# EAGLE board Mk4 Final a (EAGLE 9.0.1), part 2 of 3 (continued)
## Tracks (layer width: path | path; a pad name or v marks a point on that pad's centre or on a via) (continued)
I2C5_EXT_SCL  (via drill 0.3)  (3 unrouted)
  Top 0.2: J8.1 36.58,72.69 arc-45 36.29,71.99 35.69,71.39 arc-45 34.99,71.1 22.42,71.1 arc45 21.53,70.73 17.39,66.59 arc-45 16.69,66.3 14.32,66.3 arc45 13.43,65.93 13.07,65.57 arc45 12.7,64.68 12.7,63.27 arc-45 12.26,62.21 10.69,60.64 arc-45 9.63,60.2 3.85,60.2 arc90 2.6,58.95 2.6,48.21 arc45 2.89,47.51 4.61,45.79 arc-45 4.9,45.09 4.9,40.31 arc45 5.19,39.61 v5.3,39.5 | v38.05,71.25 arc-45 38.3,70.65 38.3,67.15 arc90 40.05,65.4 50.65,65.4 v50.8,65.25
  3V3@2 0.15: v50.8,65.25 50.8,62 51.3,61.5 55.82,61.5 56.4,60.92 56.4,58.32 58.07,56.65 58.07,56.38 58.38,56.08 58.65,56.08 63.9,50.82 v63.9,50.2
  Bottom 0.15: IC1.121 66.69,49.6 66.66,49.63 arc45 66.31,49.77 66.18,49.77 arc-45 65.47,50.07 65.01,50.53 arc45 64.66,50.67 64.58,50.67 arc45 64.23,50.53 v63.9,50.2
  Bottom 0.2: IC1.121 68.59,49.6 arc-45 68.95,49.45 69.05,49.35 arc45 69.41,49.2 70.07,49.2 arc-45 70.42,49.05 71.15,48.33 71.15,48.15 R24.1 72,47.3 72,46.95 arc45 72.13,46.63 arc-45 72.42,45.92 72.42,41.82 arc45 72.72,41.11 73.21,40.62 arc45 73.92,40.33 75.56,40.33 arc-45 76.27,40.03 82.18,34.12 arc-45 82.55,33.23 82.55,27.33 arc45 82.99,26.27 87.8,21.46 arc45 88.86,21.02 92.46,21.02 arc-45 93.34,20.66 96.91,17.09 arc-45 97.2,16.39 97.2,9.51 | JP6.6 5.25,39.45 v5.3,39.5 | PCB.SCL 97.6,5 97.2,5.4 97.2,9.51 | J8.1 36.8,73.36 36.8,72.91 arc45 37.09,72.21 v38.05,71.25 | J11.3 98.86,7.85 arc-45 98.15,8.15 97.49,8.81 arc-45 97.2,9.51
  Bottom 0.3: PCB.SCL 98.05,4.84 | J8.5 J8.1
I2C5_EXT_SDA  (via drill 0.3)  (3 unrouted)
  Top 0.2: v5.55,42 5.52,42.02 arc-45 5.3,42.57 5.3,45.24 arc45 5.01,45.94 3.29,47.66 arc-45 3,48.36 3,58.8 arc-90 4,59.8 9.67,59.8 arc45 10.91,60.31 12.59,61.99 arc45 13.1,63.23 13.1,64.64 arc-45 13.39,65.34 13.66,65.61 arc-45 14.36,65.9 16.73,65.9 arc45 17.62,66.27 21.81,70.46 arc-45 22.51,70.75 35.64,70.75 arc45 36.34,71.04 38.56,73.26 J8.2 38.56,73.24 38.7,73.1 38.7,67.3 arc90 40.2,65.8 50.6,65.8 v50.8,66
  3V3@2 0.15: v63.1,50.2 63.1,51.2 58.52,55.77 58.26,55.77 57.77,56.26 57.77,56.52 56.1,58.2 56.1,60.8 55.7,61.2 51.1,61.2 50.5,61.8 50.5,64.7 50.2,65 50.2,65.4 v50.8,66
  Bottom 0.15: IC1.120 66.72,50 arc-45 66.71,50 arc45 66.54,50.08 arc-45 65.83,50.37 65.52,50.68 arc45 64.81,50.98 64.29,50.98 arc45 63.58,50.68 v63.1,50.2
  Bottom 0.2: IC1.120 68.72,50 arc-45 69.08,49.85 69.23,49.7 arc45 69.58,49.56 70.79,49.56 arc-45 71.14,49.41 R23.1 72,48.55 arc45 72.36,48.4 72.7,48.4 arc-90 73.2,47.9 73.2,47.21 arc-45 72.91,46.51 72.77,46.38 72.77,41.96 arc45 73.07,41.26 73.36,40.97 arc45 74.06,40.67 75.71,40.67 arc-45 76.42,40.38 82.46,34.34 arc-45 82.9,33.28 82.9,27.37 arc45 83.27,26.49 87.99,21.77 arc45 88.87,21.4 93.29,21.4 arc-45 93.99,21.11 97.36,17.75 arc-45 97.65,17.04 97.65,10.92 arc45 97.94,10.21 J11.4 99.89,9.65 arc-45 100.59,9.36 103.51,6.44 arc-45 PCB.SDA | JP6.7 v5.54,41.99 v5.55,42
  Bottom 0.3: J8.6 J8.2
JOY_CEN  (via drill 0.3)  (1 unrouted)
  Top 0.15: SW1.CTR 20.57,39.02 arc45 21.46,38.66 24.59,38.66 arc-45 24.95,38.51 24.96,38.5 arc45 25.32,38.35 25.58,38.35 arc-45 25.93,38.2 27.29,36.84 arc45 28.18,36.48 34.24,36.48 arc45 34.41,36.55 34.54,36.68 arc-45 34.72,36.75 48.08,36.75 arc90 49.25,37.92 49.25,41.59 arc-90 50.36,42.7 52.65,42.7 arc90 53.9,43.95 53.9,44.35 arc-90 55.15,45.6 56.72,45.6 arc45 57.07,45.75 57.55,46.23 arc45 57.7,46.58 57.7,47.09 arc-45 57.85,47.45 v59,48.6
  Bottom 0.15: v59,48.6 58.79,48.81 arc-45 58.5,49.51 58.5,54.09 arc45 58.21,54.79 56.69,56.31 arc-45 56.4,57.01 IC1.72
JOY_DOWN  (via drill 0.3)  (1 unrouted)
  Top 0.15: v59.8,47.8 59.8,47.41 arc-45 59.51,46.71 57.65,44.85 arc-45 57.29,44.7 55.3,44.7 arc90 54.8,44.2 54.8,43.8 arc-90 52.8,41.8 50.74,41.8 arc90 50.15,41.2 50.15,37.52 arc-90 48.47,35.85 35.09,35.85 arc45 34.92,35.78 34.79,35.65 arc-45 34.61,35.58 24.88,35.58 arc45 24.53,35.43 23.95,34.85 arc-45 23.59,34.7 23.1,34.7 SW1.D
  Bottom 0.15: v59.8,47.8 59.9,47.9 59.9,48.61 arc45 59.61,49.32 59.39,49.53 arc-45 59.1,50.24 59.1,54.69 arc45 58.81,55.39 57.49,56.71 arc-45 57.2,57.41 IC1.74
JOY_LEFT  (via drill 0.3)  (1 unrouted)
  Top 0.15: SW1.C 17.45,40.35 arc45 18.15,40.06 18.66,40.06 arc-45 19.36,39.76 20.33,38.8 arc45 21.39,38.36 24.47,38.36 arc-45 24.82,38.21 24.84,38.2 arc45 25.19,38.05 25.45,38.05 arc-45 25.8,37.9 27.09,36.61 arc45 28.15,36.17 34.23,36.17 arc45 34.63,36.34 34.67,36.38 arc-45 34.84,36.45 48.19,36.45 arc90 49.55,37.81 49.55,41.46 arc-90 50.49,42.4 52.7,42.4 arc90 54.2,43.9 54.2,44.3 arc-90 55.2,45.3 56.84,45.3 arc45 57.2,45.45 57.85,46.1 arc45 58,46.46 58,46.59 arc-45 58.15,46.95 v59,47.8
  Bottom 0.15: IC1.73 56.8,57.21 arc45 57.09,56.51 58.51,55.09 arc-45 58.8,54.39 58.8,50.11 arc45 59.09,49.41 59.31,49.19 arc-45 59.6,48.49 arc-45 59.54,48.34 v59,47.8
JOY_RIGHT  (via drill 0.3)  (1 unrouted)
  Top 0.15: v59,47 58.88,47 arc45 58.53,46.85 58.45,46.77 arc45 58.3,46.42 58.3,46.33 arc-45 58.15,45.98 57.32,45.15 arc-45 56.97,45 55.25,45 arc90 54.5,44.25 54.5,43.85 arc-90 52.75,42.1 50.6,42.1 arc90 49.85,41.35 49.85,37.69 arc-90 48.31,36.15 34.97,36.15 arc45 34.79,36.08 34.66,35.95 arc-45 34.49,35.88 25.73,35.88 arc-45 25.38,36.02 SW1.B | v61.8,54.6 arc-45 62.04,54.7 v63.1,54.7
  Bottom 0.15: v61.8,54.6 60.4,54.6 arc90 59.4,53.6 59.4,50.41 arc45 59.69,49.71 60.11,49.29 arc-45 60.4,48.59 60.4,48 arc-90 59.4,47 v59,47 | IC1.91 64,59.79 64.08,59.72 64.08,59.48 arc-90 63.57,58.98 63.27,58.98 arc90 62.77,58.48 62.77,55.44 arc45 63.07,54.73 v63.1,54.7
JOY_UP  (via drill 0.3)  (1 unrouted)
  Top 0.15: SW1.A 19.2,42.2 arc-45 19.49,41.49 19.49,41 arc45 19.79,40.29 20.82,39.25 arc45 21.53,38.96 24.72,38.96 arc-45 25.07,38.81 25.09,38.8 arc45 25.44,38.65 25.7,38.65 arc-45 26.05,38.5 27.49,37.07 arc45 28.2,36.77 34.11,36.77 arc45 34.29,36.85 34.42,36.98 arc-45 34.6,37.05 47.95,37.05 arc90 48.95,38.05 48.95,41.72 arc-90 50.23,43 52.6,43 arc90 53.6,44 53.6,44.4 arc-90 55.1,45.9 56.59,45.9 arc45 56.95,46.05 57.25,46.35 arc45 57.4,46.71 57.4,47.59 arc-45 57.55,47.95 v58.2,48.6
  Bottom 0.15: IC1.71 56,56.81 arc45 56.29,56.11 57.91,54.49 arc-45 58.2,53.79 v58.2,48.6
LCD_!RST  (via drill 0.3)
  Top 0.15: v65.4,53.6 65.4,51.91 arc45 65.69,51.21 69.23,47.67 arc45 69.58,47.52 70.06,47.52 arc-45 70.41,47.38 70.75,47.05 arc45 71.1,46.9 v71.4,46.9
  Bottom 0.15: IC1.111 v65.4,53.6 | v71.4,46.9 71.81,46.49 arc-45 72.1,45.79 72.1,42.21 arc-45 71.81,41.5 71.67,41.36 arc45 71.52,41.01 71.52,40.9 arc-90 71.02,40.4 68.55,40.4 arc90 67.55,39.4 J2.10
LCD_DCX
  Bottom 0.15: J2.36 54.55,37.89 arc-45 54.84,38.59 55.01,38.76 arc45 55.3,39.46 55.3,41.69 arc-45 55.45,42.05 56.45,43.05 arc-45 56.81,43.2 56.94,43.2 arc45 57.3,43.35 58.25,44.3 arc45 58.4,44.66 IC1.20
LCD_TEAR  (via drill 0.3)
  Top 0.15: v52.95,38.5 52.95,40.19 arc-45 53.24,40.89 53.56,41.21 arc-45 54.26,41.5 54.39,41.5 arc45 55.09,41.79 55.11,41.81 arc45 55.4,42.51 v55.4,43
  Bottom 0.15: J2.39 53.05,38.26 arc45 v52.95,38.5 | IC1.21 58,44.68 arc-45 57.85,44.33 57.17,43.65 arc-45 56.82,43.5 56.68,43.5 arc45 56.33,43.35 56.12,43.15 arc-45 55.77,43 v55.4,43
LED1  (via drill 0.3)
  Top 0.15: v59.8,67.5 59.8,71.09 arc45 59.51,71.79 58.17,73.12 58.04,73.12 57.66,73.5 v57.55,73.5
  Bottom 0.15: IC1.86 62,61.23 arc90 61.3,61.92 arc-90 60.8,62.42 60.8,63.29 arc45 60.51,63.99 60.09,64.41 arc-45 59.8,65.11 v59.8,67.5 | R12.2 60.59,73.52 arc-45 59.88,73.22 57.82,73.22 v57.55,73.5
LED1_R  (via drill 0.3)
  Top 0.25: LED3.A v61.97,75.25
  Bottom 0.3: R12.1 61.32,75.25 v61.97,75.25
LED2  (via drill 0.3)
  Top 0.15: v58.8,67.55 57.55,68.8 arc-45 57.26,69.5 57.26,73.04 v56.8,73.5
  Bottom 0.15: IC1.85 61.6,61.33 arc90 61.3,61.62 61,61.62 arc-90 60.5,62.12 60.5,63.14 arc45 60.21,63.84 59.79,64.26 arc-45 59.5,64.96 59.5,66.14 arc45 59.21,66.84 59.01,67.04 arc-45 v58.8,67.55 | R14.2 57.79,74 57.77,74.03 57.53,74.03 arc45 57.18,73.88 v56.8,73.5
LED2_R  (via drill 0.3)
  Top 0.25: LED4.A v57.63,75.25
  Bottom 0.25: v57.63,75.25 58.28,75.25 R14.1
LED5_R
  Top 0.25: R11.1 28.38,11.92 30.01,10.29 arc45 30.71,10 32.3,10 32.38,9.92 32.45,9.92 LED5.A
LEDK
  pour Bottom (no thermals): 69.1,39.7 69.1,39.3 72.5,39.3 73.15,38.65 75.35,38.65 75.35,39.5 72.7,39.5 72.5,39.7
LEDK1
  Bottom 0.25: J2.2 71.55,37.34 arc-45 71.84,38.04 R47.2
LEDK2
  Bottom 0.25: J2.3 71.05,37.9 arc-45 R48.2
LEDK3
  Bottom 0.25: J2.4 70.55,37.9 arc45 R49.2
LEDK4
  Bottom 0.25: J2.5 70.05,37.34 arc45 69.76,38.04 R44.2
MIC_MUX_N
  Bottom 0.2: IC12.11 90.8,58.5 90.59,58.71 arc45 89.89,59 89.26,59 arc90 88.26,58 IC12.9 88.26,55.5 arc90 89.26,54.5 90.45,54.5 arc-90 91.45,53.5 91.45,50.22 91.38,50.15 91.38,48.85 arc90 92.4,47.83 93.1,47.83 arc-90 93.83,47.1 93.83,44.7 arc-90 93.55,44.42 93.12,44.85 IC5.10
MIC_MUX_P
  Bottom 0.2: IC12.1 94.61,51 arc-90 93.61,50 93.07,50 arc-90 92.07,51 IC12.3 92.07,50.34 92.02,50.29 arc45 91.72,49.59 91.72,48.85 arc90 92.4,48.17 93.1,48.17 arc-90 94.17,47.1 94.17,44.7 arc-90 93.55,44.08 93.22,43.75 IC5.9
MIC_N
  Bottom 0.2: C56.2 C53.1 | C52.2 C55.1 | C52.2 C56.2 | U4.- 95.83,69.25 96.4,69.83 97.12,69.83 arc-90 97.62,69.33 97.62,66.33 C52.2 | C56.2 97.62,64.67 97.62,64.21 arc-45 97.48,63.85 97.47,63.85 arc45 97.33,63.49 S22.6
MIC_P
  Bottom 0.2: C52.1 C54.1 | C56.1 C57.1 | C52.1 C56.1 | U4.+ 95.83,70.75 96.4,70.17 97.22,70.17 arc-90 97.97,69.42 97.97,66.35 98.3,66.03 C52.1 | C56.1 97.97,64.67 97.97,64.21 arc45 98.12,63.85 99.83,62.15 arc45 100.18,62 S22.3
MIC_PWM_AMP
  Bottom 0.15: C79.1 79.83,57.73 IC11.1 | IC11.2 80.47,55.23 80.7,55
  Bottom 0.2: C81.2 C80.2 80.7,55 | IC11.1 IC11.2
MIC_PWM_AMP_+
  Bottom 0.15: IC11.3 81.12,57.22 arc45 80.98,57.57 C78.2
  Bottom 0.2: C78.2 R52.2
MIC_PWM_N
  Bottom 0.2: IC12.8 86.99,56 arc-90 85.99,55 R54.1 C80.1
MIC_PWM_P
  Bottom 0.2: IC12.4 90.8,53 arc90 89.8,54 R54.2 C81.1
MIC_PWM_R
  Bottom 0.2: R53.1 C79.2 R52.1
MIC_SWITCHED_N
  Bottom 0.2: IC12.10 89.53,56 arc90 90.53,55 93.47,55 arc-45 93.61,54.94 93.74,54.81 arc45 93.88,54.75 95.8,54.75 95.88,54.67 96.06,54.67 arc45 96.77,54.97 97.77,55.97 arc-45 97.91,56.02 98.47,56.02 arc45 98.82,56.17 98.98,56.33 arc45 99.13,56.68 99.13,57.97 arc45 98.98,58.32 97.8,59.5 S22.5
MIC_SWITCHED_P  (via drill 0.3)  (1 unrouted)
  3V3@2 0.2: v28.86,76.32 arc-14 59.8,79.5 arc-7 78.8,78.5 arc-12 98.55,74 101.8,70.75 101.8,58.5 v101.55,58.25
  Bottom 0.2: IC12.2 93.34,54.05 arc-90 93.54,54.25 95.8,54.25 95.88,54.33 96.21,54.33 arc45 96.91,54.62 97.91,55.62 arc-45 98.05,55.67 98.61,55.67 arc45 98.97,55.82 99.31,56.17 arc-45 99.46,56.23 101.05,56.23 arc90 101.55,56.73 v101.55,58.25 102.3,59 102.8,59 103.27,59.48 S22.2 | J9.1 29.57,75.19 arc45 29.28,75.9 v28.86,76.32
MUX_A  (via drill 0.3)
  Top 0.15: v68.95,56.2 69.2,56.45 arc-45 69.56,56.6 69.71,56.6 arc-45 69.95,56.5 74.7,56.5 arc45 74.84,56.56 74.95,56.67 arc-45 75.09,56.73 76.11,56.73 arc-45 76.25,56.67 76.36,56.56 arc45 76.5,56.5 78.69,56.5 arc45 78.88,56.58 arc-45 79.23,56.73 89.11,56.73 arc45 89.82,57.02 v92.3,59.5
  Bottom 0.15: IC1.105 68.75,56 v68.95,56.2
  Bottom 0.2: IC12.12 92.07,59.27 v92.3,59.5 R56.1 93.34,59.29 IC12.13
MUX_B  (via drill 0.3)
  Top 0.15: v88.05,49 87.34,49.71 arc45 86.64,50 82.31,50 arc-45 81.61,50.29 79.89,52.01 arc-45 79.6,52.71 79.6,55.2 arc90 78.6,56.2 76.37,56.2 arc-45 76.23,56.26 76.12,56.37 arc45 75.98,56.42 75.22,56.42 arc45 75.08,56.37 74.97,56.26 arc-45 74.83,56.2 70.11,56.2 arc45 69.75,56.05 v69.7,56
  Bottom 0.15: R55.2 v88.05,49 | IC1.106 69.3,55.6 v69.7,56
  Bottom 0.2: IC12.6 88.26,49.96 R55.2 88.11,49.75 arc45 88.81,50.04 89.07,50.3 89.1,50.3 89.53,50.73 IC12.5
N$1
  cutout GND@3 (no thermals): 21.7,28.9 21.7,28.85 21.7,28.9 22.04,29.24 arc-90 22.46,29.24 22.64,29.06 arc-90 22.64,28.64 19.95,25.95 19.95,25.8 arc-90 19.65,25.5 19.55,25.5 arc-90 19.25,25.8 19.25,26.4 21.7,28.85
N$2
  cutout GND@3 (no thermals): 16.9,30.5 16.9,26.8 17.65,26.05 17.65,25.75 arc-90 17.35,25.45 17.25,25.45 arc-90 16.95,25.75 16.2,26.5 16.2,31 17.09,31.89 arc-90 17.51,31.89 17.69,31.71 arc-90 17.69,31.29
N$3
  cutout GND@3 (no thermals): 15.9,30.6 15.9,26.6 16.45,26.05 16.45,25.75 arc-90 16.15,25.45 16.05,25.45 arc-90 15.75,25.75 15.2,26.3 15.2,30.1 14.41,30.89 arc-90 14.41,31.31 14.59,31.49 arc-90 15.01,31.49
N$4
  cutout 3V3@2: 79.9,5 79.9,8.75 83.9,8.75 83.9,5
  cutout GND@3: 79.9,5 79.9,8.75 83.9,8.75 83.9,5
NETLIGHT_R
  Bottom 0.15: IC5.41 97,32 arc-90 96,31 90.55,31 R42.2
OSC0
  Bottom 0.15: IC1.88 62.8,64.2 C16.2 62.55,65.91 arc45 62.26,66.62 X2.1
OSC1
  Bottom 0.15: IC1.89 63.2,62.1 R6.1
OSC1_R
  Bottom 0.15: R6.2 C17.2 63.55,65.47 X2.3
POWER_SWITCH  (via drill 0.3)
  Top 0.15: v61.05,9 60.82,9.23 arc45 60.11,9.53 59.83,9.53 59.81,9.5 38.51,9.5 arc-45 37.81,9.79 37.12,10.48 arc-45 36.82,11.19 36.82,12.86 arc-45 37.12,13.57 v37.55,14
  Bottom 0.15: Q3.4 38.1,14.2 R13.1 v37.55,14 | S18.3 61.41,8.85 arc-45 v61.05,9
PWM2_SPK_PWM  (via drill 0.3)
  3V3@2 0.15: v47.8,52.25 48.05,52 48.05,43.75 45.8,41.5 v45.3,41.5
  Bottom 0.15: IC1.44 49.26,51.2 arc-45 48.56,51.49 v47.8,52.25 | v45.3,41.5 31.78,41.5 arc-45 31.64,41.56 31.56,41.64 arc45 31.42,41.7 30.71,41.7 arc-45 30.01,41.99 29.64,42.36 arc-45 29.35,43.06 29.35,44.43 arc45 28.98,45.32 27.54,46.76 arc45 27.01,46.98 26.77,46.98 arc-90 26.27,47.48 26.27,47.69 arc45 26.09,48.13 arc-45 25.8,48.84 25.8,59.4 arc90 24.8,60.4 C105.2
PWM3_MIC_PWM  (via drill 0.3)
  Top 0.15: v75.5,54.3 75.19,54.61 arc45 74.49,54.9 70.19,54.9 70.17,54.88 68.78,54.88 arc-45 68.08,55.17 65.36,57.88 arc45 65.01,58.02 61.44,58.02 arc45 60.73,57.73 59.09,56.09 arc45 58.8,55.39 58.8,52.7 arc-90 57.8,51.7 54.28,51.7 arc-45 v53.8,51.9
  Bottom 0.15: IC1.45 53.09,51.6 arc45 v53.79,51.89 v53.8,51.9 | v75.5,54.3 75.19,54.61 arc-45 74.9,55.31 74.9,57.75 arc-90 75.9,58.75 R53.2
PWM6_LCD_BLIGHT  (via drill 0.3)
  Top 0.15: v74.9,36.8 74.9,45.2 arc90 73.9,46.2 68.79,46.2 arc-45 68.08,46.49 64.65,49.92 v64.65,50.15 | v53.3,58.6 53.83,58.07 arc-45 53.97,57.72 53.97,57.35 arc90 54.72,56.6 v58.6,56.6
  3V3@2 0.15: v58.6,56.6 64.65,50.55 v64.65,50.15
  Bottom 0.15: Q8.3 75.22,37.33 arc-45 75.08,36.98 v74.9,36.8 | IC1.63 53.1,58.8 v53.3,58.6
PWR_KEY_FET
  Bottom 0.15: IC5.39 99.2,31.25 arc-90 97.7,29.75 91.47,29.75 Q1.3
RBIAS+
  Bottom 0.2: IC1.59 50.6,57.2 R3.1
SDRAM_!CAS  (via drill 0.3)
  Top 0.15: v43.3,50.25 43.76,50.71 arc-45 44.46,51 57.9,51 arc90 59.4,52.5 59.4,54.69 arc-45 59.69,55.39 v60.3,56
  Bottom 0.15: IC2.17 42.75,50.3 42.8,50.25 v43.3,50.25 | IC1.83 60.8,56.91 arc-45 60.51,56.21 v60.3,56
SDRAM_!CS  (via drill 0.3)
  Top 0.15: v63.3,56.75 62.96,56.41 arc-45 62.69,56.3 arc45 61.98,56.01 60.29,54.32 arc45 60,53.61 60,52.4 arc-90 58,50.4 45.36,50.4 arc45 44.66,50.11 v43.3,48.75
  Bottom 0.15: IC2.19 42.23,48.75 v43.3,48.75 | IC1.103 66.35,56.8 arc-45 66.23,56.75 v63.3,56.75
SDRAM_!RAS  (via drill 0.3)
  Top 0.15: v43.3,49.5 44.21,50.41 arc-45 44.91,50.7 57.95,50.7 arc90 59.7,52.45 59.7,54.24 arc-45 59.99,54.94 v61.05,56
  Bottom 0.15: IC2.18 v43.3,49.5 | IC1.84 61.2,56.36 arc-45 v61.05,56
SDRAM_!WE  (via drill 0.3)
  Top 0.15: v63.3,57.5 61.34,57.5 arc45 60.63,57.21 59.39,55.97 arc45 59.1,55.26 59.1,52.62 arc-90 57.85,51.38 44.09,51.38 arc45 43.38,51.08 v43.3,51
  Bottom 0.15: IC2.16 42.7,51.1 42.8,51 v43.3,51 | IC1.92 64.4,59.01 arc-45 64.11,58.31 v63.3,57.5
SDRAM_A0  (via drill 0.3)
  Top 0.15: v36.8,61.5 v36.8,61.49 36.77,61.47 36.77,56.27 36.82,56.22 36.82,51.7 arc45 37.12,50.99 37.53,50.58 arc-90 37.53,49.17 37.07,48.7 arc45 36.77,48 36.77,46.52 36.82,46.47 36.82,46.03 36.8,46.01 v36.8,45.5 | v52.1,45.5 51.79,45.19 arc-45 51.09,44.9 44.31,44.9 arc-45 43.61,45.19 v43.3,45.5
  Bottom 0.15: IC2.2 38.01,62.3 arc45 37.31,62.01 v36.8,61.5 | IC1.29 54.8,46.02 arc90 54.3,46.52 53.92,46.52 | v43.3,45.5 IC2.23 v36.8,45.5 | 53.92,46.52 | 53.92,46.52 53.48,46.52 arc45 52.88,46.28 v52.1,45.5
SDRAM_A1  (via drill 0.3)
  Top 0.15: v52.1,44.75 arc-45 51.74,44.6 43.66,44.6 arc-45 v43.3,44.75 | v39.55,60.5 39.91,60.14 arc-45 40.2,59.44 40.2,58.13 arc45 40.24,58.03 arc-45 40.3,57.89 v40.3,44.75
  Bottom 0.15: v39.55,60.5 arc-45 40.03,60.7 IC2.4 | IC1.30 54.4,45.98 arc90 54.15,46.23 53.48,46.23 arc45 53.13,46.08 53.01,45.96 arc45 52.8,45.45 arc-90 v52.1,44.75 | v43.3,44.75 42.87,44.75 arc45 42.75,44.7 IC2.24 41.6,44.7 41.55,44.75 v40.3,44.75
SDRAM_A2  (via drill 0.3)
  Top 0.15: v39.5,59.75 39.53,59.72 arc-45 39.82,59.01 39.82,46.4 39.77,46.35 39.77,44.02 v39.8,44 | v52.1,44 v52.09,44.01 arc45 51.39,44.3 44.01,44.3 arc45 v43.31,44.01 v43.3,44
  Bottom 0.15: v39.5,59.75 arc-45 39.86,59.9 IC2.5 | v43.3,44 42.88,44 arc45 42.74,43.94 42.7,43.9 IC2.25 41.65,43.9 41.61,43.94 arc45 41.47,44 v39.8,44 | IC1.31 54,43.85 arc-90 53.5,43.35 52.6,43.35 arc-90 52.1,43.85 v52.1,44 v52.1,43.99
SDRAM_A3  (via drill 0.3)
  Top 0.15: v39.3,58.25 39.27,58.23 39.27,43.27 v39.3,43.25 | v43.3,43.25 43.76,43.71 arc-45 44.46,44 50.94,44 arc-45 51.64,43.71 51.82,43.53 arc90 52.53,43.53 v53,44
  Bottom 0.15: v43.3,43.25 42.8,43.25 42.65,43.1 IC2.26 41.7,43.1 41.61,43.19 arc45 41.47,43.25 v39.3,43.25 | v53,44 53.1,44 arc90 53.6,44.5 IC1.32 | v39.3,58.25 39.32,58.25 39.37,58.2 40.4,58.2 arc-45 40.55,58.14 40.57,58.11 arc90 41.63,58.11 41.82,58.3 IC2.7
SDRAM_A4  (via drill 0.3)
  Top 0.15: v43.3,57.5 44.38,56.42 arc45 45.09,56.12 54.51,56.12 arc-45 55.22,55.83 v56.05,55 | v38.55,57.5 38.75,57.3 arc-45 38.9,56.94 38.9,43.76 arc-45 38.75,43.4 v38.35,43
  Bottom 0.15: IC1.22 57.6,53.04 arc45 57.31,53.74 v56.05,55 | v38.55,57.5 IC2.8 v43.3,57.5 | IC2.29 31.39,43.1 arc-45 31.49,43.06 arc45 31.63,43 v38.35,43
SDRAM_A5  (via drill 0.3)
  Top 0.15: v35.8,56.75 35.77,56.73 35.77,55.58 arc45 35.82,55.48 arc-45 35.88,55.34 35.88,51.8 arc45 36.17,51.09 37.03,50.23 arc-90 37.03,49.52 36.07,48.55 arc45 35.77,47.85 35.77,45.4 35.82,45.35 35.82,44.02 v35.8,44 | v56.05,54 55.34,54.71 arc45 54.64,55 51.47,55 arc-45 51.33,55.06 51.32,55.07 arc45 51.18,55.12 44.59,55.12 arc-45 43.88,55.42 v43.3,56
  Bottom 0.15: v56.05,54 56.91,53.14 arc-45 57.2,52.44 IC1.23 | v35.8,56.75 35.89,56.75 arc-45 36.59,56.46 36.76,56.29 arc45 37.46,56 41.22,56 arc-45 41.36,55.94 arc45 41.46,55.9 IC2.10 42.62,55.9 arc45 42.76,55.96 arc-45 42.86,56 v43.3,56 | IC2.30 31.39,43.9 arc45 31.49,43.94 arc-45 31.63,44 v35.8,44
SDRAM_A6  (via drill 0.3)
  Top 0.15: v35.3,55.25 35.3,53.74 35.32,53.72 35.32,51.93 arc45 35.62,51.22 36.79,50.05 arc-90 36.79,49.7 35.59,48.5 arc45 35.3,47.8 v35.3,44.75 | v56.05,53.25 54.89,54.41 arc45 54.19,54.7 51.35,54.7 arc-45 51.21,54.76 51.2,54.77 arc45 51.06,54.83 44.14,54.83 arc-45 43.43,55.12 v43.3,55.25
  Bottom 0.15: v56.05,53.25 56.51,52.79 arc-45 56.8,52.09 IC1.24 | v35.3,55.25 41.22,55.25 arc-45 41.36,55.19 41.39,55.16 arc45 41.53,55.1 IC2.11 42.57,55.1 arc45 42.71,55.16 42.74,55.19 arc-45 42.88,55.25 v43.3,55.25 | IC2.31 31.5,44.7 arc-45 31.62,44.75 v35.3,44.75
SDRAM_A7  (via drill 0.3)
  Top 0.15: v56.1,52.3 54.29,54.11 arc45 53.59,54.4 51.22,54.4 arc-45 51.08,54.46 51.08,54.47 arc45 50.93,54.52 44.74,54.52 arc45 44.03,54.23 v43.3,53.5 | v34.8,53.5 34.8,50.83 arc-45 34.51,50.12 33.94,49.56 arc45 33.65,48.85 33.65,46.81 arc45 33.94,46.11 v34.55,45.5
  Bottom 0.15: v43.3,53.5 IC2.13 v34.8,53.5 | IC2.32 v34.55,45.5 | IC1.25 56.4,47.26 56.42,47.28 56.42,51.56 arc45 56.13,52.27 v56.1,52.3
SDRAM_A8  (via drill 0.3)
  Top 0.15: v49.55,48.1 v49.54,48.09 arc-45 48.84,47.8 43.55,47.8 arc90 42.3,46.55 42.3,45.5 arc-45 42.01,44.79 39.68,42.47 arc-45 38.98,42.17 36.54,42.17 arc-45 35.83,42.47 v32.05,46.25 31.09,47.21 arc-45 30.8,47.91 30.8,49.33 arc45 30.51,50.03 29.27,51.27 arc-45 29.2,51.45 29.2,52.69 arc-45 29.35,53.05 v29.8,53.5
  Bottom 0.15: IC2.42 v29.8,53.5 | IC2.33 31.5,46.3 arc45 31.62,46.25 v32.05,46.25 | IC1.40 51.46,49.6 arc45 50.76,49.31 v49.55,48.1
SDRAM_A9  (via drill 0.3)
  Top 0.15: v29.55,47.25 29.55,48.34 arc45 29.26,49.05 29.18,49.12 arc-45 28.96,49.65 28.96,50.58 arc45 28.89,50.76 28.67,50.98 arc-45 28.6,51.16 28.6,53.24 arc-45 28.75,53.59 28.82,53.67 arc45 28.96,54.02 28.96,54.25 arc-45 29.26,54.96 v29.55,55.25 | v50.45,49.75 49.12,48.42 arc-45 48.41,48.12 43.3,48.12 arc90 41.8,46.62 41.8,45.42 arc-45 41.51,44.72 39.56,42.77 arc-45 38.85,42.48 37,42.48 arc-45 36.29,42.77 32.84,46.22 arc-45 32.55,46.92 v32.55,47
  Bottom 0.15: IC2.44 30.45,55.1 30.45,55.1 arc45 30.09,55.25 v29.55,55.25 | v29.55,47.25 30.09,47.25 arc-45 30.45,47.1 IC2.34 32.31,47.1 arc-45 v32.55,47 | IC1.41 51.05,50 arc45 v50.45,49.75
SDRAM_A10  (via drill 0.3)
  Top 0.15: v43.3,46.25 43.38,46.17 53.15,46.17 arc45 53.86,46.47 54.7,47.31 arc45 54.85,47.66 v54.85,47.8 | v36.3,46.25 36.3,47.95 arc-45 36.59,48.65 37.28,49.34 arc90 37.28,50.4 36.59,51.09 arc-45 36.3,51.8 v36.3,56
  Bottom 0.15: IC2.45 31.62,55.9 arc45 31.76,55.96 arc-45 31.86,56 v36.3,56 | v43.3,46.25 42.8,46.25 42.75,46.3 IC2.22 41.6,46.3 arc-45 41.48,46.25 v36.3,46.25 | IC1.50 53.34,53.6 arc-45 54.04,53.31 54.56,52.79 arc-45 54.85,52.09 v54.85,47.8
SDRAM_A11  (via drill 0.3)
  Top 0.15: v28.8,57.5 28.8,56.41 arc-45 28.51,55.71 arc45 28.3,55.21 28.3,54.49 28.32,54.47 28.32,54.1 arc-45 28.27,53.98 28.27,53.97 28.15,53.84 arc45 28,53.49 28,50.91 arc45 28.07,50.73 28.2,50.6 arc-45 28.27,50.42 28.27,48.53 28.3,48.51 v28.3,48 | v41.05,48.75 42.48,50.18 arc45 42.77,50.89 42.77,51.71 arc-45 43.07,52.42 44.26,53.61 arc-45 44.96,53.9 49.74,53.9 arc-45 50.44,53.61 50.76,53.29 arc45 51.46,53 v53.55,53
  Bottom 0.15: IC2.47 v28.8,57.5 | v28.3,48 30.22,48 arc-45 30.36,47.94 30.4,47.9 IC2.35 36.29,47.9 arc45 36.99,48.19 37.26,48.46 arc-45 37.96,48.75 v41.05,48.75 | IC1.49 53.07,53.2 arc-45 v53.55,53
SDRAM_A12  (via drill 0.3)
  Top 0.15: v28.8,48.75 28.8,49.08 28.66,49.22 28.66,50.46 arc45 28.59,50.64 28.37,50.85 arc-45 28.3,51.03 28.3,53.37 arc-45 28.45,53.72 28.52,53.79 arc45 28.66,54.14 28.66,54.95 arc-45 28.96,55.66 29.26,55.96 arc45 29.55,56.66 v29.55,58.25 33.33,62.03 arc-45 34.04,62.33 44.53,62.33 44.59,62.38 arc-90 46.01,62.38 46.22,62.17 56.77,62.17 arc-45 v57.27,61.97
  Bottom 0.15: IC2.48 30.35,58.3 30.3,58.25 v29.55,58.25 | IC2.36 30.35,48.7 30.3,48.75 v28.8,48.75 | v57.27,61.97 57.6,61.64 IC1.75
SDRAM_BA0  (via drill 0.3)
  Top 0.15: v37.8,48 37.8,48.38 arc-45 37.95,48.73 38.09,48.88 arc90 38.09,50.87 arc-45 37.8,51.57 v37.8,60 38.53,60.73 arc-45 39.24,61.02 39.56,61.02 arc-45 39.91,60.88 39.97,60.82 arc45 40.32,60.67 41.18,60.67 arc45 41.54,60.82 41.72,61.01 arc-45 42.43,61.3 44.76,61.3 44.95,61.11 arc90 45.65,61.11 45.82,61.27 55.49,61.27 arc-45 55.85,61.13 56.05,60.93 arc45 56.25,60.84 arc-45 56.6,60.7 v57.8,59.5
  Bottom 0.15: IC2.50 37.7,59.9 v37.8,60 | IC2.20 41.71,47.9 arc-45 41.61,47.94 arc45 41.47,48 v37.8,48 | v57.8,59.5 arc45 58,59.98 IC1.76
SDRAM_BA1  (via drill 0.3)
  Top 0.15: v37.3,47 37.27,47.02 37.27,48.07 arc-45 37.57,48.78 37.78,48.99 arc90 37.78,50.76 37.57,50.97 arc-45 37.27,51.67 37.27,60.73 v37.3,60.75 37.76,61.21 arc-45 38.46,61.5 39.89,61.5 arc-45 40.6,61.21 40.68,61.13 arc90 41.42,61.13 41.6,61.31 arc-45 42.31,61.6 44.66,61.6 44.95,61.89 arc-90 45.65,61.89 45.97,61.58 55.62,61.58 arc-45 55.97,61.43 56.11,61.29 arc45 56.46,61.15 57.3,61.15 arc-90 58.3,60.15 58.3,60.1 arc45 v58.55,59.5
  Bottom 0.15: v37.3,47 42.08,47 IC2.21 | v37.3,60.75 37.25,60.7 IC2.51 | v58.55,59.5 arc-45 58.4,59.86 IC1.77
SDRAM_CKE  (via drill 0.3)
  Top 0.15: v29.55,49.5 30.01,49.04 arc-45 30.3,48.34 30.3,47.41 arc45 30.59,46.71 35.28,42.02 arc45 35.99,41.73 39.09,41.73 arc45 39.79,42.02 42.48,44.71 arc45 42.77,45.41 42.77,46.5 arc-90 43.77,47.5 52.09,47.5 arc45 52.8,47.79 54.67,49.66 arc-45 55.73,50.1 58.05,50.1 arc90 60.3,52.35 60.3,53.49 arc-45 60.59,54.19 62.11,55.71 arc-45 62.81,56 v63.3,56
  Bottom 0.15: IC1.104 66.53,56.4 arc45 66.39,56.34 66.33,56.28 arc-45 66.19,56.23 63.55,56.23 63.32,56 v63.3,56 | v29.55,49.5 IC2.37
SDRAM_CLK  (via drill 0.3)
  Top 0.15: v32.8,58 31.8,58 arc90 30.8,57 30.8,55.5 29.32,54.02 arc45 29.27,53.91 arc-45 29.13,53.55 29.05,53.47 arc45 28.9,53.12 28.9,51.28 arc45 28.97,51.1 29.2,50.87 arc-45 29.27,50.7 29.27,50.52 v29.5,50.3 | v41.03,58.5 v50.05,58.5
  Bottom 0.15: v41.03,58.5 39.97,58.5 arc-45 39.66,58.63 arc45 39.31,58.77 33.99,58.77 arc45 33.28,58.48 v32.8,58 | IC1.62 50.15,58.4 v50.05,58.5 | IC2.38 v29.5,50.3
SDRAM_D15  (via drill 0.3)
  Top 0.15: v57.8,62.5 56.74,62.5 arc-45 56.68,62.48 46.34,62.48 46.18,62.63 arc90 44.42,62.63 44.41,62.62 33.09,62.62 arc45 32.38,62.33 v32.3,62.25
  Bottom 0.15: IC2.53 32.25,62.3 v32.3,62.25 | IC1.78 58.8,61.52 arc90 58.6,61.73 58.47,61.73 arc-90 58.27,61.92 58.27,61.94 arc45 58.22,62.08 v57.8,62.5
SDRAM_DQMH  (via drill 0.3)